# EasyEDA Pro project FPGA-G1.eprj, schematic Schematic1, sheets 1 to 6 of 10 (continued)
## Sheets (continued)
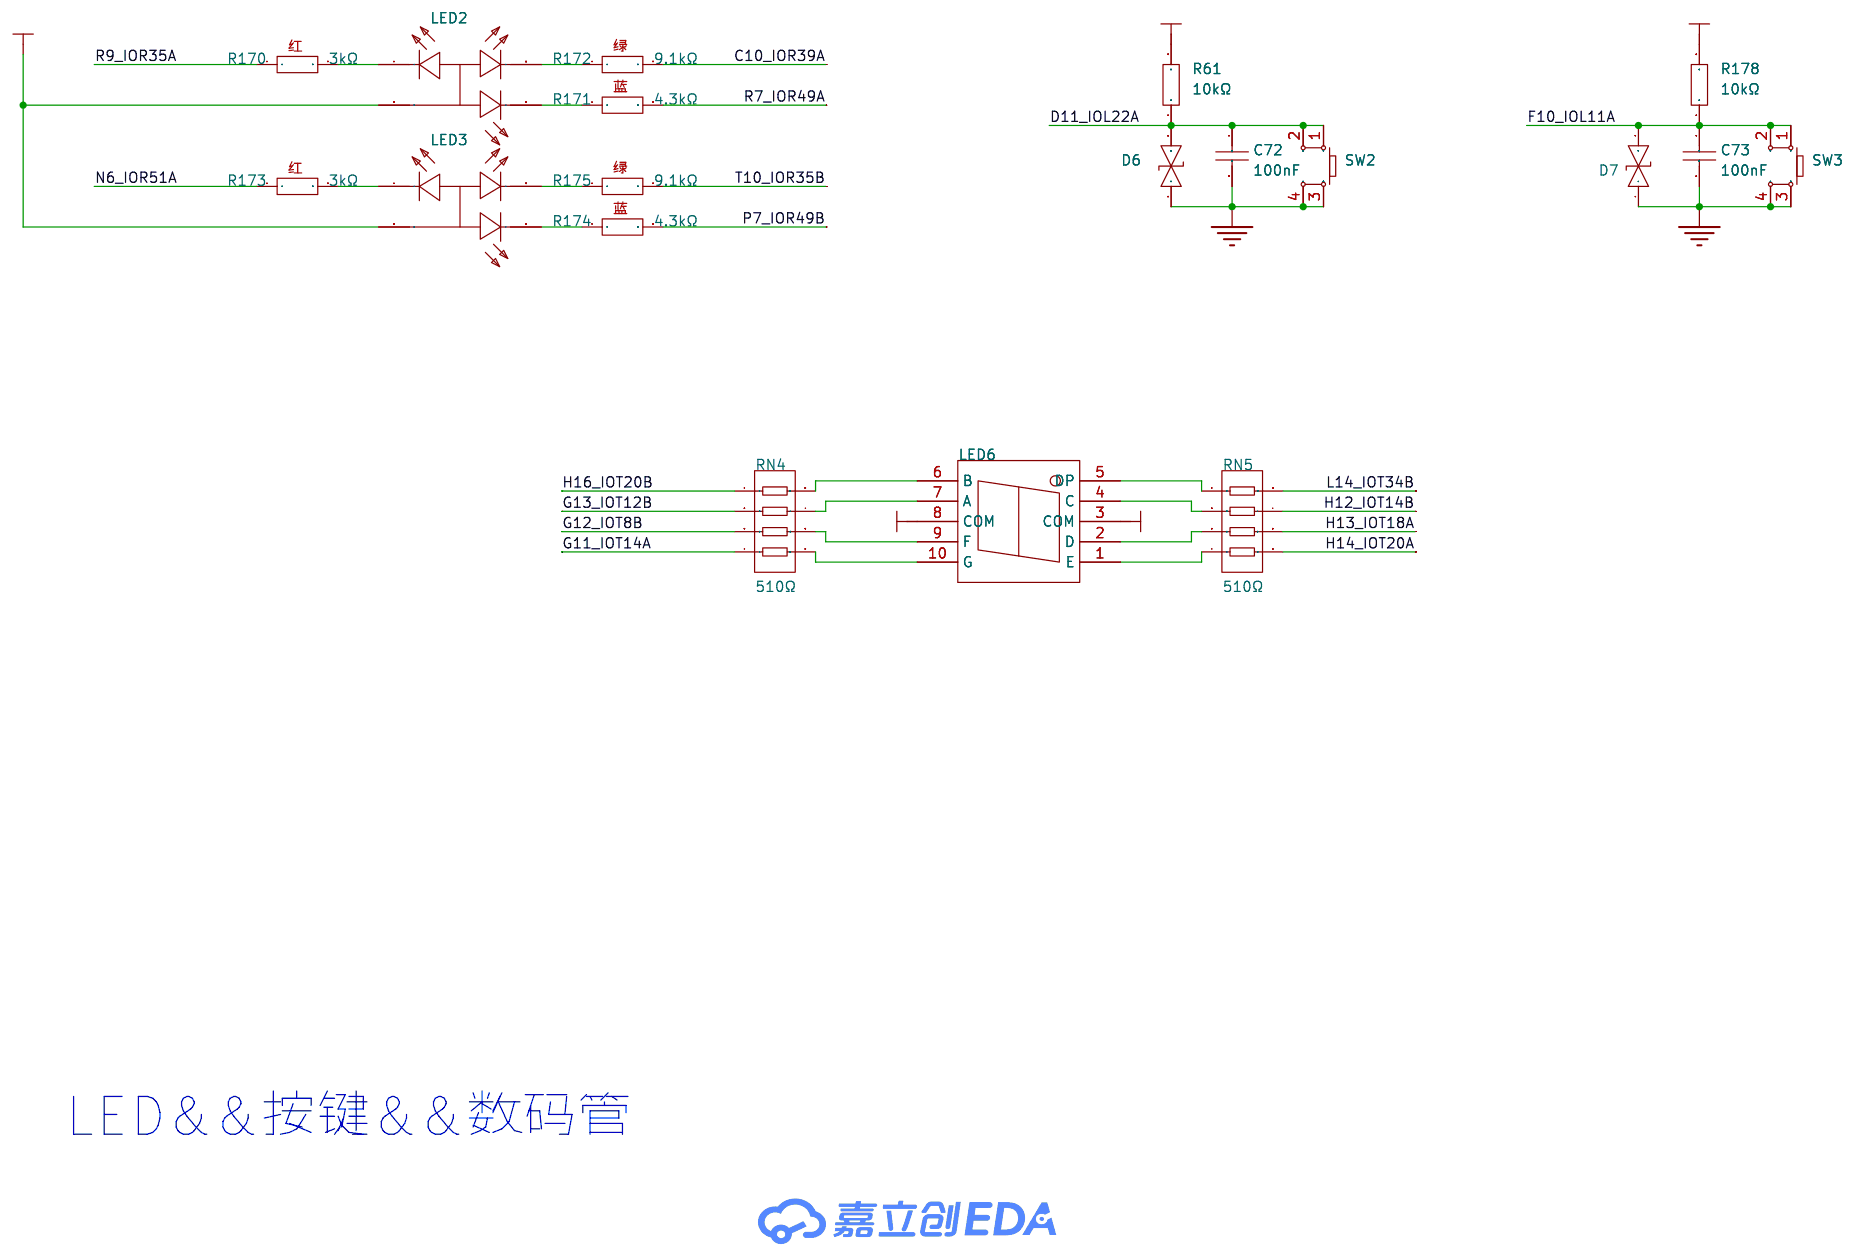
[diagram p5: FPGA_Peripheral]

## Parts
sheet FPGA
H1  -  [125 X 300]
H2  -  [125 X 300]
H3  -  [125 X 300]
H4  -  [125 X 300]
R9  10kΩ  [R0402]
R133  4.7kΩ  [R0402]
R134  4.7kΩ  [R0402]
R135  4.7kΩ  [R0402]
R136  4.7kΩ  [R0402]
R137  4.7kΩ  [R0402]
R138  4.7kΩ  [R0402]
U7  -  [FBGA-256_L17.0-W17.0-R16-C16-P1.00-TL-1]  (sections Bank0-1,Bank2-3,Bank4-5,Bank6-7,Config,Power)
U12  -  [测试点0.8mm]
U13  -  [测试点0.8mm]
U14  -  [测试点0.8mm]
U15  -  [测试点0.8mm]
U16  -  [测试点0.8mm]
U17  -  [测试点0.8mm]
U18  -  [测试点0.8mm]
sheet FPGA_DDR3
C31  100nF  [C0402]
C32  100nF  [C0402]
C33  100nF  [C0402]
C34  100nF  [C0402]
C35  100nF  [C0402]
C96  2.2uF  [C0402]
C97  2.2uF  [C0402]
C98  2.2uF  [C0402]
C99  2.2uF  [C0402]
C100  100nF  [C0402]
C101  100nF  [C0402]
C102  100nF  [C0402]
C103  100nF  [C0402]
C104  100nF  [C0402]
C105  100nF  [C0402]
C140  100nF  [C0402]
C141  100nF  [C0402]
C142  100nF  [C0402]
R106  100Ω  [R0402]
R109  1kΩ  [R0402]
R110  49.9Ω  [R0402]
R111  49.9Ω  [R0402]
R112  49.9Ω  [R0402]
R113  49.9Ω  [R0402]
R114  49.9Ω  [R0402]
R115  49.9Ω  [R0402]
R116  49.9Ω  [R0402]
R117  49.9Ω  [R0402]
R118  49.9Ω  [R0402]
R119  49.9Ω  [R0402]
R120  49.9Ω  [R0402]
R121  49.9Ω  [R0402]
R122  49.9Ω  [R0402]
R123  49.9Ω  [R0402]
R124  49.9Ω  [R0402]
R125  49.9Ω  [R0402]
R126  49.9Ω  [R0402]
R127  49.9Ω  [R0402]
R128  49.9Ω  [R0402]
R129  49.9Ω  [R0402]
R130  1kΩ  [R0402]
R131  1kΩ  [R0402]
R132  240Ω  [R0402]
U29  MT41J128M16JT-125-K  [FBGA-96_L14.0-W9.0-R16-C6-P0.80-TL]
sheet FPGA_DDR3_Power
C23  100nF  [C0402]
C74  2.2uF  [C0402]
C75  10uF  [C0402]
C76  10uF  [C0402]
C77  100nF  [C0402]
C81  2.2uF  [C0402]
C82  2.2uF  [C0402]
C83  2.2uF  [C0402]
C84  100nF  [C0402]
C85  100nF  [C0402]
C88  100nF  [C0402]
C89  100nF  [C0402]
C119  1nF  [C0402]
C134  10uF  [C0402]
C135  10uF  [C0402]
C136  10uF  [C0402]
C137  100nF  [C0402]
C138  100nF  [C0402]
C139  100nF  [C0402]
L8  MPZ1608S101ATAH0  [L0603]
L9  MPZ1608S101ATAH0  [L0603]
R73  0Ω  [R0402]
R74  100kΩ  [R0402]
R75  10kΩ  [R0402]
R76  10kΩ  [R0402]
U23  TPS51200DRCR  [WSON-10_L3.0-W3.0-P0.50-BL-EP]
sheet FPGA_HDMI
C68  100nF  [C0402]
C69  10uF  [C0603]
D4  1N5819WS  [SOD-323_L1.8-W1.3-LS2.5-RD]
D9  RCLAMP0524P  [DFN2510-10_L2.5-W1.0-P0.50-BL]
D10  RCLAMP0524P  [DFN2510-10_L2.5-W1.0-P0.50-BL]
R143  0Ω  [R0402]
R144  0Ω  [R0402]
R145  0Ω  [R0402]
R146  0Ω  [R0402]
R147  0Ω  [R0402]
R148  0Ω  [R0402]
R149  0Ω  [R0402]
R150  0Ω  [R0402]
R152  10kΩ  [R0402]
R153  10kΩ  [R0402]
R154  10kΩ  [R0402]
R155  10kΩ  [R0402]
USB3  -  [hdmi-smd_hdmi-101s]
sheet FPGA_JTAG
C21  22uF  [C0603]
C56  100nF  [C0402]
C57  100nF  [C0402]
L16  UPZ1005D121-1R3TF  [L0402]
LED4  F.0603.00139/P2-0603R1TS2-06T-002  [LED0603-RD]
R17  22Ω  [R0402]
R18  33Ω  [R0402]
R19  33Ω  [R0402]
R20  4.7kΩ  [R0402]
R30  4.7kΩ  [R0402]
R31  4.7kΩ  [R0402]
R151  1kΩ  [R0402]
R176  4.7kΩ  [R0603]
RN1  33Ω  [RES-ARRAY-SMD_0402-8P-L2.0-W1.0-BL]
TP11  -  [Test-Point-0.5mm]
TP12  -  [Test-Point-0.5mm]
TP13  -  [Test-Point-0.5mm]
TP14  -  [Test-Point-0.5mm]
TP15  -  [Test-Point-0.5mm]
TP16  -  [Test-Point-0.5mm]
U20  ZX-SH1.0-8PWT  [CONN-SMD_8P-P1.00_MEGASTAR_ZX-SH1.0-8PWT]
U30  W25Q64JVSSIQ  [SOP-8_L5.3-W5.3-P1.27-LS8.0-BL]
X3  50MHz  [OSC-SMD_4P-L3.2-W2.5-BL]
sheet FPGA_Peripheral
C72  100nF  [C0402]
C73  100nF  [C0402]
D6  0402ESDA-05N  [D0402-BI]
D7  0402ESDA-05N  [D0402-BI]
LED2  E6C0606RGBC3UDA  [LED-SMD_4P-L1.6-W1.6-TL-FD]
LED3  E6C0606RGBC3UDA  [LED-SMD_4P-L1.6-W1.6-TL-FD]
LED6  SLS0281FR1A1GD  [LED-SEG-SMD_SLS0281FR1A1GD]
R61  10kΩ  [R0402]
R170  3kΩ  [R0402]
R171  4.3kΩ  [R0402]
R172  9.1kΩ  [R0402]
R173  3kΩ  [R0402]
R174  4.3kΩ  [R0402]
R175  9.1kΩ  [R0402]
R178  10kΩ  [R0402]
RN4  510Ω  [RES-ARRAY-SMD_0402-8P-L2.0-W1.0-BL]
RN5  510Ω  [RES-ARRAY-SMD_0402-8P-L2.0-W1.0-BL]
SW2  PTS815SJK250SMTRLFS  [SW-SMD_4P-L4.2-W3.3-P2.15-LS5.1]
SW3  PTS815SJK250SMTRLFS  [SW-SMD_4P-L4.2-W3.3-P2.15-LS5.1]

## Library data of the parts
H1-H4 = 125 X 300: Check: false
R9 R61 R75 R76 R152-R155 R178 = 0402WGF1002TCE: 电阻类型:厚膜电阻;阻值:10kΩ;精度:±1%;功率:62.5mW;温度系数:±100ppm/℃;; LCSC Part Name: 厚膜电阻 10kΩ ±1% 62.5mW; Supplier Part: C25744; Manufacturer: UNI-ROYAL(厚声); Supplier Footprint: 0402; JLCPCB Part Class: 基础库; Datasheet: https://atta.szlcsc.com/upload/public/pdf/source/20200306/C422600_1E6D84923E4A46A82E41ADD87F860B5C.pdf; Supplier: LCSC; Type: 厚膜电阻; Tolerance: ±1%; Power(Watts): 62.5mW; Temperature Coefficient: ±100ppm/℃; Overload Voltage (Max): 50V; Operating Temperature Range: -55℃~+155℃
R20 R30 R31 R133-R138 = 0402WGF4701TCE: 电阻类型:厚膜电阻;阻值:4.7kΩ;精度:±1%;功率:62.5mW;温度系数:±100ppm/℃;; LCSC Part Name: 厚膜电阻 4.7kΩ ±1% 62.5mW; Supplier Part: C25900; Manufacturer: UNI-ROYAL(厚声); Supplier Footprint: 0402; JLCPCB Part Class: 基础库; Datasheet: https://atta.szlcsc.com/upload/public/pdf/source/20200306/C422600_1E6D84923E4A46A82E41ADD87F860B5C.pdf; Supplier: LCSC; Type: 厚膜电阻; Tolerance: ±1%; Power(Watts): 62.5mW; Temperature Coefficient: ±100ppm/℃; Overload Voltage (Max): 50V; Operating Temperature Range: -55℃~+155℃
U7 = gw2a-lv18pg256
U12-U18 = 测试点: 测试点，直径0.8mm，一般用于电源; Check: false
C23 C31-C35 C56 C57 C68 C72 C73 C77 C84 C85 C88 C89 C100-C105 C137-C142 = CL05B104KO5NNNC: 容值:100nF;精度:±10%;额定电压:16V;材质(温度系数):X7R;; LCSC Part Name: 100nF ±10% 16V; Supplier Part: C1525; Manufacturer: SAMSUNG(三星); Supplier Footprint: 0402; JLCPCB Part Class: 基础库; Datasheet: https://atta.szlcsc.com/upload/public/pdf/source/20160218/1457707763339.pdf; Supplier: LCSC; Tolerance: ±10%; Voltage Rated: 16V; Temperature Coefficient: X7R
C74 C81-C83 C96-C99 = CL05A225MQ5NSNC: 容值:2.2uF;精度:±20%;额定电压:6.3V;材质(温度系数):X5R;; LCSC Part Name: 2.2uF ±20% 6.3V; Supplier Part: C12530; Manufacturer: SAMSUNG(三星); Supplier Footprint: 0402; JLCPCB Part Class: 基础库; Datasheet: https://atta.szlcsc.com/upload/public/pdf/source/20160103/1457707666860.pdf; Supplier: LCSC; Tolerance: ±20%; Voltage Rated: 6.3V; Temperature Coefficient: X5R
R106 = 0402WGF1000TCE: 电阻类型:厚膜电阻;阻值:100Ω;精度:±1%;功率:62.5mW;温度系数:±200ppm/℃;; LCSC Part Name: 厚膜电阻 100Ω ±1% 62.5mW; Supplier Part: C25076; Manufacturer: UNI-ROYAL(厚声); Supplier Footprint: 0402; JLCPCB Part Class: 基础库; Datasheet: https://atta.szlcsc.com/upload/public/pdf/source/20200306/C422600_1E6D84923E4A46A82E41ADD87F860B5C.pdf; Supplier: LCSC; Type: 厚膜电阻; Tolerance: ±1%; Power(Watts): 62.5mW; Temperature Coefficient: ±200ppm/℃; Overload Voltage (Max): 50V; Operating Temperature Range: -55℃~+155℃
R109 R130 R131 R151 = 0402WGF1001TCE: 电阻类型:厚膜电阻;阻值:1kΩ;精度:±1%;功率:62.5mW;; LCSC Part Name: 1kΩ ±1% 62.5mW; Supplier Part: C11702; Manufacturer: UNI-ROYAL(厚声); Supplier Footprint: 0402; JLCPCB Part Class: 基础库; Datasheet: https://atta.szlcsc.com/upload/public/pdf/source/20200306/C422600_1E6D84923E4A46A82E41ADD87F860B5C.pdf; Supplier: LCSC; Type: 厚膜电阻; Tolerance: ±1%; Power(Watts): 62.5mW; Temperature Coefficient: ±100ppm/℃; Overload Voltage (Max): 50V; Operating Temperature Range: -55℃~+155℃
R110-R129 = 0402WGF499JTCE: 电阻类型:厚膜电阻;阻值:49.9Ω;精度:±1%;功率:62.5mW;温度系数:±100ppm/℃;; LCSC Part Name: 厚膜电阻 49.9Ω ±1% 62.5mW; Supplier Part: C25120; Manufacturer: UNI-ROYAL(厚声); Supplier Footprint: 0402; JLCPCB Part Class: 基础库; Datasheet: https://atta.szlcsc.com/upload/public/pdf/source/20200306/C422600_1E6D84923E4A46A82E41ADD87F860B5C.pdf; Supplier: LCSC; Type: 厚膜电阻; Tolerance: ±1%; Power(Watts): 62.5mW; Temperature Coefficient: ±100ppm/℃; Overload Voltage (Max): 50V; Operating Temperature Range: -55℃~+155℃
R132 = 0402WGF2400TCE: 电阻类型:厚膜电阻;阻值:240Ω;精度:±1%;功率:62.5mW;温度系数:±100ppm/℃;; LCSC Part Name: 厚膜电阻 240Ω ±1% 62.5mW; Supplier Part: C25094; Manufacturer: UNI-ROYAL(厚声); Supplier Footprint: 0402; JLCPCB Part Class: 扩展库; Datasheet: https://atta.szlcsc.com/upload/public/pdf/source/20200306/C422600_1E6D84923E4A46A82E41ADD87F860B5C.pdf; Supplier: LCSC; Type: 厚膜电阻; Tolerance: ±1%; Power(Watts): 62.5mW; Temperature Coefficient: ±100ppm/℃; Overload Voltage (Max): 50V; Operating Temperature Range: -55℃~+155℃
U29 = MT41J128M16JT-125-K: LCSC Part Name: MT41J128M16JT-125:K; Supplier Part: C5128616; Manufacturer: micron(镁光); Supplier Footprint: FBGA-96; JLCPCB Part Class: 扩展库; Datasheet: https://atta.szlcsc.com/upload/public/pdf/source/20220810/F0A01CE8EB48673B41D7B913ED7D9A50.pdf; Supplier: LCSC
C75 C76 C134-C136 = CL05A106MQ5NUNC: 容值:10uF;精度:±20%;额定电压:6.3V;材质(温度系数):X5R;; LCSC Part Name: 10uF ±20% 6.3V; Supplier Part: C15525; Manufacturer: SAMSUNG(三星); Supplier Footprint: 0402; JLCPCB Part Class: Basic Part; Datasheet: https://atta.szlcsc.com/upload/public/pdf/source/20220823/2B02EE04F8F211D38A52DCB16EB6BEBA.pdf; Supplier: LCSC; Tolerance: ±20%; Voltage Rated: 6.3V; Temperature Coefficient: X5R
C119 = 0402B102K500NT: 容值:1nF;精度:±10%;额定电压:50V;材质(温度系数):X7R;; LCSC Part Name: 1nF ±10% 50V; Supplier Part: C1523; Manufacturer: FH(风华); Supplier Footprint: 0402; JLCPCB Part Class: 基础库; Datasheet: https://atta.szlcsc.com/upload/public/pdf/source/20200305/C486355_26A10D38EF8C2A5C37091D0039909270.pdf; Supplier: LCSC; Tolerance: ±10%; Voltage Rated: 50V; Temperature Coefficient: X7R
L8 L9 = MPZ1608S101ATAH0: 标称阻抗@测试频率:100Ω@100MHz;误差:±25%;直流电阻(RDC):30mΩ;额定电流:3A;电路数:1;; LCSC Part Name: 100Ω@100MHz ±25%; Supplier Part: C107332; Manufacturer: TDK; Supplier Footprint: SMD; JLCPCB Part Class: 扩展库; Datasheet: https://atta.szlcsc.com/upload/public/pdf/source/20170420/1492670790894.pdf; Supplier: LCSC; Impedance @ Frequency: 100Ω@100MHz; Tolerance: ±25%; DC Resistance: 30mΩ; Current Rating: 3A; Circuits: 1
R73 R143-R150 = 0402WGF0000TCE: 电阻类型:厚膜电阻;阻值:0Ω;精度:±1%;功率:62.5mW;; LCSC Part Name: 0Ω ±1% 62.5mW; Supplier Part: C17168; Manufacturer: UNI-ROYAL(厚声); Supplier Footprint: 0402; JLCPCB Part Class: 基础库; Datasheet: https://atta.szlcsc.com/upload/public/pdf/source/20200306/C422600_1E6D84923E4A46A82E41ADD87F860B5C.pdf; Supplier: LCSC; Type: 厚膜电阻; Tolerance: ±1%; Power(Watts): 62.5mW; Temperature Coefficient: ±800ppm/℃; Overload Voltage (Max): 50V; Operating Temperature Range: -55℃~+155℃
R74 = 0402WGF1003TCE: 电阻类型:厚膜电阻;阻值:100kΩ;精度:±1%;功率:62.5mW;; LCSC Part Name: 100kΩ ±1% 62.5mW; Supplier Part: C25741; Manufacturer: UNI-ROYAL(厚声); Supplier Footprint: 0402; JLCPCB Part Class: Basic Part; Datasheet: https://atta.szlcsc.com/upload/public/pdf/source/20200306/C422600_1E6D84923E4A46A82E41ADD87F860B5C.pdf; Supplier: LCSC; Type: 厚膜电阻; Tolerance: ±1%; Power(Watts): 62.5mW; Temperature Coefficient: ±100ppm/℃; Overload Voltage (Max): 50V; Operating Temperature Range: -55℃~+155℃
U23 = TPS51200DRCR: 输出电压:-;; Supplier: LCSC; Manufacturer: TI(德州仪器); Supplier Part: C34771; JLCPCB Part Class: 扩展库; Supplier Footprint: DFN-10(3x3); Datasheet: https://www.ti.com/cn/lit/gpn/tps51200; Number of Outputs: 1; Operating Temperature: -40℃~+85℃
C69 = CL10A106KP8NNNC: 容值:10uF;精度:±10%;额定电压:10V;材质(温度系数):X5R;; LCSC Part Name: 10uF ±10% 10V; Supplier Part: C19702; Manufacturer: SAMSUNG(三星); Supplier Footprint: 0603; JLCPCB Part Class: 基础库; Datasheet: https://atta.szlcsc.com/upload/public/pdf/source/20160103/1457707703378.pdf; Supplier: LCSC; Tolerance: ±10%; Voltage Rated: 10V; Temperature Coefficient: X5R
D4 = 1N5819WS_C191023: 直流反向耐压(Vr):40V;平均整流电流(Io):1A;正向压降(Vf):600mV@1A;; LCSC Part Name: 40V 1A 600mV@1A; Supplier Part: C191023; Manufacturer: Hottech(合科泰); Supplier Footprint: SOD-323; JLCPCB Part Class: 基础库; Datasheet: https://atta.szlcsc.com/upload/public/pdf/source/20220428/3CB86FD8D28D653594B4E35F9D5AEFD9.pdf; Supplier: LCSC; Reverse Voltage (Vr): 40V; Average Rectified Current (Io): 1A; Forward Voltage (Vf@If): 600mV@1A
D9 D10 = RCLAMP0524P_C907837: Supplier Part: C907837; Manufacturer: TECH PUBLIC(台舟); Supplier Footprint: DFN2510-10; JLCPCB Part Class: Extended Part; Datasheet: https://atta.szlcsc.com/upload/public/pdf/source/20210810/AE3DE9AC94AD2A317FD9BEA10653400F.pdf; Supplier: LCSC
USB3 = HDMI-101S: Supplier: LCSC; Supplier Part: C720620; Manufacturer: XUNPU(讯普)
C21 = GRM188R61A226ME15D: 容值:22uF;精度:±20%;额定电压:10V;材质(温度系数):X5R;; LCSC Part Name: 22uF ±20% 10V; Supplier Part: C84419; Manufacturer: muRata(村田); Supplier Footprint: 0603; JLCPCB Part Class: 扩展库; Datasheet: https://atta.szlcsc.com/upload/public/pdf/source/20161024/1477288637384.pdf; Supplier: LCSC; Tolerance: ±20%; Voltage Rated: 10V; Temperature Coefficient: X5R
L16 = UPZ1005D121-1R3TF: 标称阻抗@测试频率:120Ω@100MHz;误差:±25%;直流电阻(RDC):90mΩ;; LCSC Part Name: 单路 0402磁珠 阻抗120Ω@100MHz; Supplier Part: C96993; Manufacturer: Sunlord(顺络); Supplier Footprint: 0402; JLCPCB Part Class: 扩展库; Datasheet: https://atta.szlcsc.com/upload/public/pdf/source/20210916/3C06D8971A361A4569490E57F6B8A429.pdf; Supplier: LCSC; Impedance @ Frequency: 120Ω@100MHz; Tolerance: ±25%; DC Resistance: 90mΩ; Current Rating: 1.3A; Circuits: 1
LED4 = F.0603.00139/P2-0603R1TS2-06T-002: 发光颜色:红色;正向电流:-;透镜颜色:-;发光角度:120°;工作温度:-40℃~+85℃;; Supplier Part: C7496820; Manufacturer: TUOZHAN(拓展光电); Supplier Footprint: 0603; JLCPCB Part Class: 扩展库; Datasheet: https://atta.szlcsc.com/upload/public/pdf/source/20230809/2283CFC12D1EC1C972D0489FE4CEE0B0.pdf; Supplier: LCSC; Emitted Color: 红色; Viewing Angle: 120°; Operating Temperature: -40℃~+85℃
R17 = 0402WGF220JTCE: 电阻类型:厚膜电阻;阻值:22Ω;精度:±1%;功率:62.5mW;温度系数:±100ppm/℃;; LCSC Part Name: 厚膜电阻 22Ω ±1% 62.5mW; Supplier Part: C25092; Manufacturer: UNI-ROYAL(厚声); Supplier Footprint: 0402; JLCPCB Part Class: Basic Part; Datasheet: https://atta.szlcsc.com/upload/public/pdf/source/20200306/C422600_1E6D84923E4A46A82E41ADD87F860B5C.pdf; Supplier: LCSC; Type: 厚膜电阻; Tolerance: ±1%; Power(Watts): 62.5mW; Temperature Coefficient: ±100ppm/℃; Overload Voltage (Max): 50V; Operating Temperature Range: -55℃~+155℃
R18 R19 = 0402WGF330JTCE: 电阻类型:厚膜电阻;阻值:33Ω;精度:±1%;功率:62.5mW;温度系数:±100ppm/℃;; LCSC Part Name: 厚膜电阻 33Ω ±1% 62.5mW; Supplier Part: C25105; Manufacturer: UNI-ROYAL(厚声); Supplier Footprint: 0402; JLCPCB Part Class: Basic Part; Datasheet: https://atta.szlcsc.com/upload/public/pdf/source/20200306/C422600_1E6D84923E4A46A82E41ADD87F860B5C.pdf; Supplier: LCSC; Type: 厚膜电阻; Tolerance: ±1%; Power(Watts): 62.5mW; Temperature Coefficient: ±100ppm/℃; Overload Voltage (Max): 50V; Operating Temperature Range: -55℃~+155℃
R176 = TC0350F4701T5E_C179829: 温度系数:±50ppm/℃;精度:±1%;阻值:4.7kΩ;功率:1/6W;工作温度范围:-55℃~+155℃;最大工作电压:75V;; LCSC Part Name: 4.7kΩ ±1%; Supplier Part: C179829; Manufacturer: UNI-ROYAL(厚声); Manufacturer Part: TC0350F4701T5E; Supplier Footprint: 0603; Datasheet: https://atta.szlcsc.com/upload/public/pdf/source/20190107/C179829_59D99BA947CB5DBA78EB915107344832.pdf; Supplier: LCSC; Temperature Coefficient: ±50ppm/℃; Tolerance: ±1%; Power(Watts): 1/6W; Operating Temperature Range: -55℃~+155℃; Overload Voltage (Max): 75V